# EasyEDA Pro project Dex_split.eprj, board lets_go
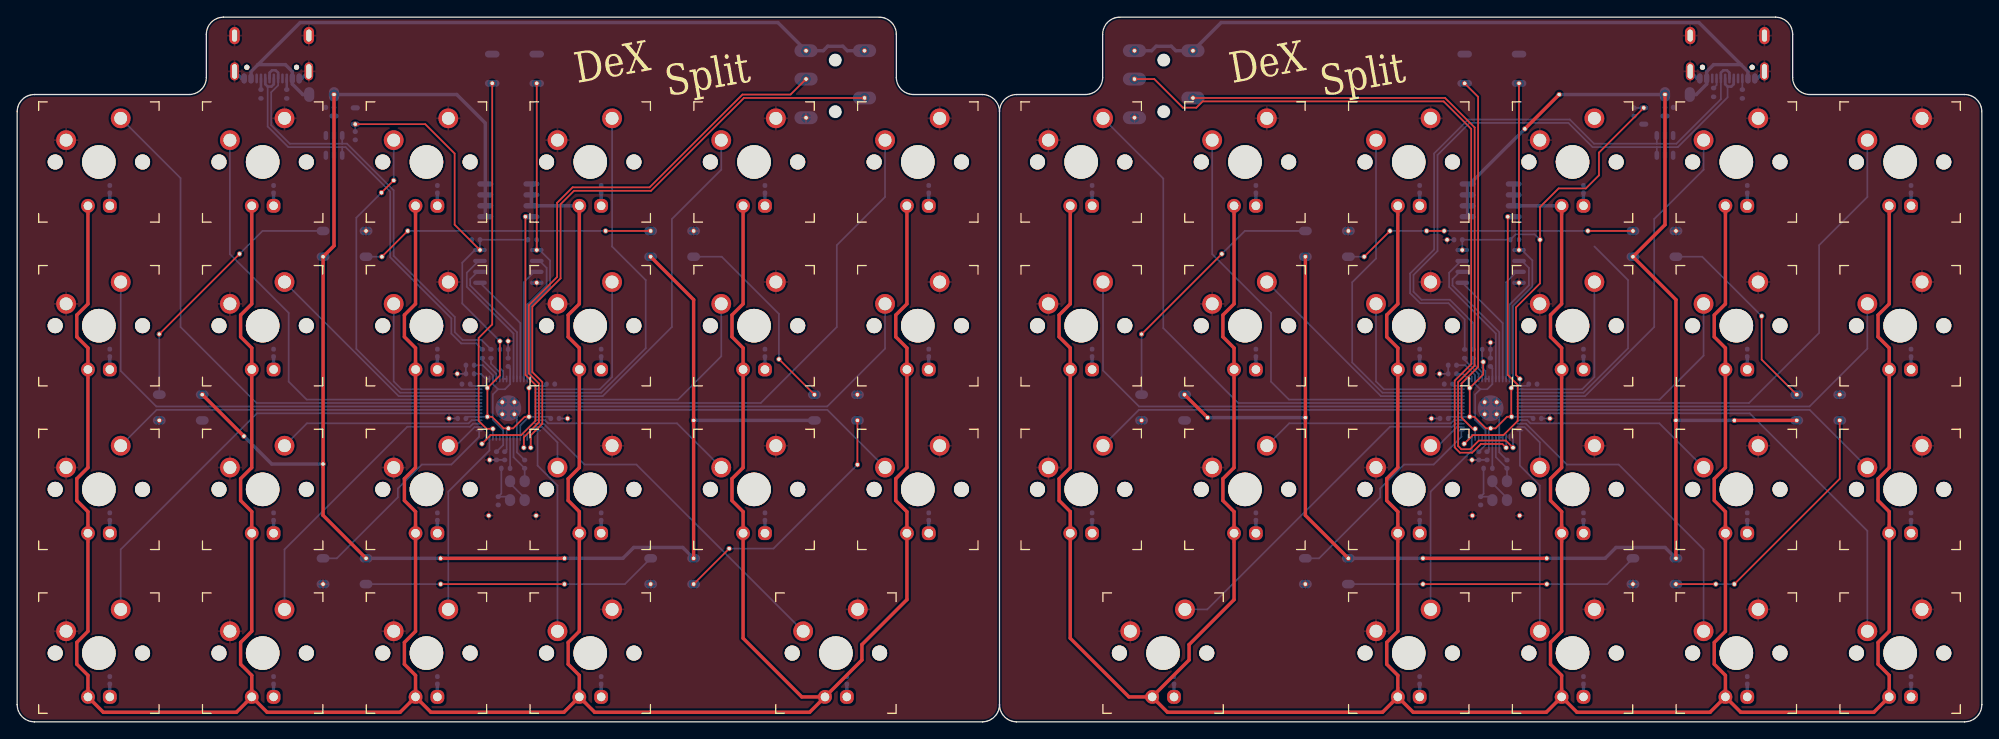
[diagram p0: board, top side]
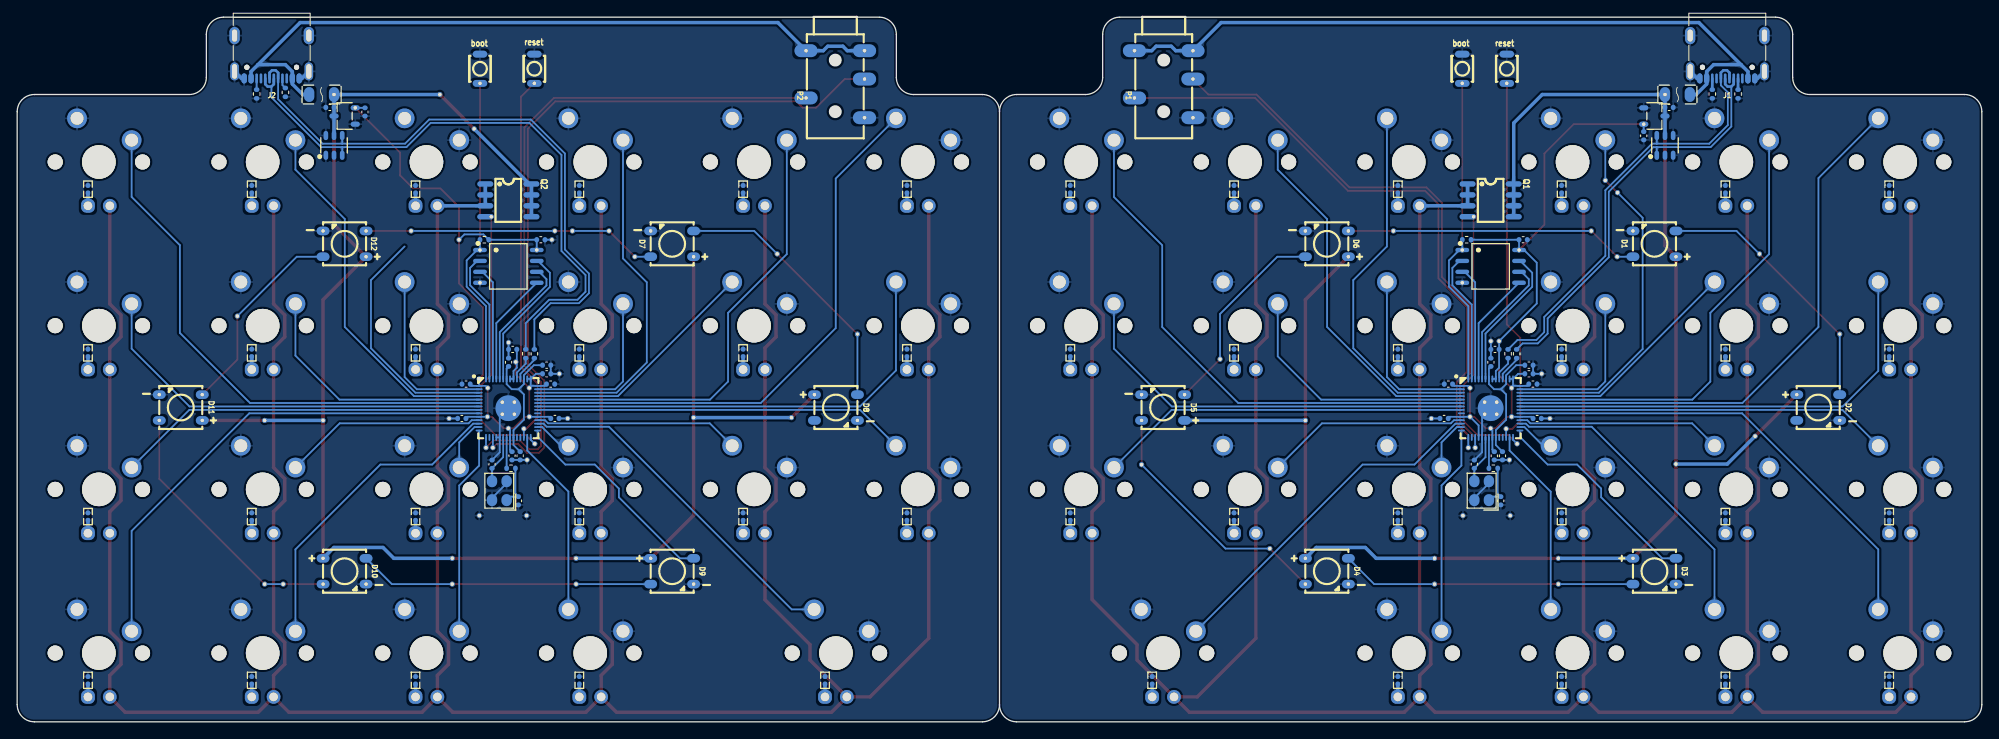
[diagram p1: board, bottom side, seen from below]

Outline 228.5 x 82 mm; copper layers: Top Layer, Bottom Layer. Coordinates in mm from the lower left corner of the outline.
Outline path: 114.25,71 arc(113.66,72.41) 112.25,73 104.25,73 arc(102.84,73.59) 102.25,75 102.25,80 arc(101.66,81.41) 100.25,82 24,82 arc(22.59,81.41) 22,80 22,75 arc(21.41,73.59) 20,73 2,73 arc(0.59,72.41) 0,71 0,2 arc(0.59,0.59) 2,0 112.25,0 arc(113.66,0.59) 114.25,2 ; 114.25,71 114.25,2 ; 114.25,71 arc(114.84,72.41) 116.25,73 124.25,73 arc(125.66,73.59) 126.25,75 126.25,80 arc(126.84,81.41) 128.25,82 204.5,82 arc(205.91,81.41) 206.5,80 206.5,75 arc(207.09,73.59) 208.5,73 226.5,73 arc(227.91,72.41) 228.5,71 228.5,2 arc(227.91,0.59) 226.5,0 116.25,0 arc(114.84,0.59) 114.25,2
Stack: Top Layer 0.035mm / Dielectric1 1.51mm FR4 er 4.5 / Bottom Layer 0.035mm

## Design rules (mm)
template: Custom Config
spacing copperThickness1oz (default): track to track 0.2, other pairs 0.152 to 0.3
spacing copperThickness2oz: track to track 0.203, other pairs 0.152 to 0.3
track width copperThickness1oz (default): min 0.127, default 0.254, max 2.54
track width copperThickness2oz: min 0.203, default 0.254, max 2.54
differential pair differentialPair (default): width min 0.127, default 0.254, max 2.54; gap min 0.152, default 0.152
via viaSize (default): diameter min 0.5, default 0.61, max 10; hole min 0.3, default 0.305, max 6.3

## Placement (name value [footprint] x y rotation side)
C1  1u  [Capacitor_SMD:C_0402_1005Metric]  192.13 71.5 0 bottom
C2  1u  [Capacitor_SMD:C_0402_1005Metric]  188.05 70.97 270 bottom
C4  1u  [Capacitor_SMD:C_0402_1005Metric]  166.92 41.5 180 bottom
C5  1u  [Capacitor_SMD:C_0402_1005Metric]  171.35 41.84 90 bottom
C6  100n  [Capacitor_SMD:C_0402_1005Metric]  166.46 39.3 180 bottom
C7  100n  [Capacitor_SMD:C_0402_1005Metric]  176.29 39.3 0 bottom
C8  100n  [Capacitor_SMD:C_0402_1005Metric]  170.87 43.34 0 bottom
C9  100n  [Capacitor_SMD:C_0402_1005Metric]  170.95 30.96 270 bottom
C10  22p  [Capacitor_SMD:C_0402_1005Metric]  170.21 25.72 90 bottom
C11  22p  [Capacitor_SMD:C_0402_1005Metric]  173.28 29.98 270 bottom
C12  100n  [Capacitor_SMD:C_0402_1005Metric]  167.59 56.1 180 bottom
C13  1u  [Capacitor_SMD:C_0402_1005Metric]  52.67 41.5 180 bottom
C14  1u  [Capacitor_SMD:C_0402_1005Metric]  57.1 41.84 90 bottom
C16  100n  [Capacitor_SMD:C_0402_1005Metric]  52.21 39.3 180 bottom
C17  100n  [Capacitor_SMD:C_0402_1005Metric]  56.62 43.34 0 bottom
C18  1u  [Capacitor_SMD:C_0402_1005Metric]  52.67 40.5 180 bottom
C19  100n  [Capacitor_SMD:C_0402_1005Metric]  51.71 35.3 180 bottom
C20  1u  [Capacitor_SMD:C_0402_1005Metric]  36.37 71.5 180 bottom
C21  22p  [Capacitor_SMD:C_0402_1005Metric]  59.03 29.98 270 bottom
C22  22p  [Capacitor_SMD:C_0402_1005Metric]  55.95 25.72 90 bottom
C23  1u  [Capacitor_SMD:C_0402_1005Metric]  39.32 68.2 270 bottom
C24  100n  [Capacitor_SMD:C_0402_1005Metric]  53.34 56.1 180 bottom
C59  1u  [Capacitor_SMD:C_0402_1005Metric]  170 30.96 270 bottom
C60  100n  [Capacitor_SMD:C_0402_1005Metric]  165.96 35.3 180 bottom
C61  100n  [Capacitor_SMD:C_0402_1005Metric]  176.79 35.3 0 bottom
C62  1u  [Capacitor_SMD:C_0402_1005Metric]  166.92 40.5 180 bottom
C63  100n  [Capacitor_SMD:C_0402_1005Metric]  56.7 30.96 270 bottom
C64  100n  [Capacitor_SMD:C_0402_1005Metric]  62.54 35.3 0 bottom
C65  100n  [Capacitor_SMD:C_0402_1005Metric]  62.04 39.3 0 bottom
C66  1u  [Capacitor_SMD:C_0402_1005Metric]  55.75 30.96 270 bottom
D1  XL-5050RGBC-WS2812B  [LED-SMD_4P-L5.0-W5.0-BL_XL-5050RGBC]  38.08 55.62 90 bottom
D2  XL-5050RGBC-WS2812B  [LED-SMD_4P-L5.0-W5.0-BL_XL-5050RGBC]  19.02 36.58 270 bottom
D3  XL-5050RGBC-WS2812B  [LED-SMD_4P-L5.0-W5.0-BL_XL-5050RGBC]  38.08 17.53 270 bottom
D4  XL-5050RGBC-WS2812B  [LED-SMD_4P-L5.0-W5.0-BL_XL-5050RGBC]  76.17 17.53 270 bottom
D5  XL-5050RGBC-WS2812B  [LED-SMD_4P-L5.0-W5.0-BL_XL-5050RGBC]  95.22 36.58 90 bottom
D6  XL-5050RGBC-WS2812B  [LED-SMD_4P-L5.0-W5.0-BL_XL-5050RGBC]  76.17 55.62 90 bottom
D7  XL-5050RGBC-WS2812B  [LED-SMD_4P-L5.0-W5.0-BL_XL-5050RGBC]  152.32 55.62 90 bottom
D8  XL-5050RGBC-WS2812B  [LED-SMD_4P-L5.0-W5.0-BL_XL-5050RGBC]  133.28 36.58 270 bottom
D9  XL-5050RGBC-WS2812B  [LED-SMD_4P-L5.0-W5.0-BL_XL-5050RGBC]  152.32 17.53 270 bottom
D10  XL-5050RGBC-WS2812B  [LED-SMD_4P-L5.0-W5.0-BL_XL-5050RGBC]  190.43 17.53 270 bottom
D11  XL-5050RGBC-WS2812B  [LED-SMD_4P-L5.0-W5.0-BL_XL-5050RGBC]  209.47 36.58 90 bottom
D12  XL-5050RGBC-WS2812B  [LED-SMD_4P-L5.0-W5.0-BL_XL-5050RGBC]  190.43 55.62 90 bottom
F1  JK-nSMD050-30  [F1206]  35.41 73 0 bottom
F3  JK-nSMD050-30  [F1206]  193.09 73 180 bottom
J1  TYPE-C 16PIN 2MD(073)  [Connector_USB:USB_C_Receptacle_Palconn_UTC16-G]  29.6 77.5 0 bottom
J2  TYPE-C 16PIN 2MD(073)  [Connector_USB:USB_C_Receptacle_Palconn_UTC16-G]  198.9 77.5 0 bottom
LMX_SW1  -  [CHERRY_MX_MILMAX]  9.5 65.15 0 top
LMX_SW2  -  [CHERRY_MX_MILMAX]  28.55 65.15 0 top
LMX_SW3  -  [CHERRY_MX_MILMAX]  47.6 65.15 0 top
LMX_SW4  -  [CHERRY_MX_MILMAX]  66.65 65.15 0 top
LMX_SW5  -  [CHERRY_MX_MILMAX]  85.7 65.15 0 top
LMX_SW6  -  [CHERRY_MX_MILMAX]  104.75 65.15 0 top
LMX_SW7  -  [CHERRY_MX_MILMAX]  9.5 46.1 0 top
LMX_SW8  -  [CHERRY_MX_MILMAX]  28.55 46.1 0 top
LMX_SW9  -  [CHERRY_MX_MILMAX]  47.6 46.1 0 top
LMX_SW10  -  [CHERRY_MX_MILMAX]  66.65 46.1 0 top
LMX_SW11  -  [CHERRY_MX_MILMAX]  85.7 46.1 0 top
LMX_SW12  -  [CHERRY_MX_MILMAX]  104.75 46.1 0 top
LMX_SW13  -  [CHERRY_MX_MILMAX]  9.5 27.05 0 top
LMX_SW14  -  [CHERRY_MX_MILMAX]  28.55 27.05 0 top
LMX_SW15  -  [CHERRY_MX_MILMAX]  47.6 27.05 0 top
LMX_SW16  -  [CHERRY_MX_MILMAX]  66.65 27.05 0 top
LMX_SW17  -  [CHERRY_MX_MILMAX]  85.7 27.05 0 top
LMX_SW18  -  [CHERRY_MX_MILMAX]  104.75 27.05 0 top
LMX_SW19  -  [CHERRY_MX_MILMAX]  9.5 8 0 top
LMX_SW20  -  [CHERRY_MX_MILMAX]  28.55 8 0 top
LMX_SW21  -  [CHERRY_MX_MILMAX]  47.6 8 0 top
LMX_SW22  -  [CHERRY_MX_MILMAX]  66.65 8 0 top
LMX_SW23  -  [CHERRY_MX_MILMAX]  95.22 8 0 top
NOREF  -  [Pad_e500]  189.18 71.45 0 top
NOREF#2  -  [Pad_e77]  149.82 54.12 0 top
NOREF#3  -  [Pad_e348]  129.95 70.3 0 top
NOREF#4  -  [Pad_e1802]  206.97 38.08 0 top
NOREF#5  -  [Pad_e353]  91.75 74.8 0 top
NOREF#6  -  [Pad_e1674]  55.25 74.3 0 top
NOREF#7  -  [Pad_e307]  49.25 16.03 0 top
NOREF#8  -  [Pad_e2623]  26.37 33.23 0 top
NOREF#9  -  [Pad_e3924]  54.85 24 0 top
NOREF#10  -  [Pad_e1706]  163.5 16.03 0 top
NOREF#11  -  [Pad_e1560]  64.02 35.3 0 top
NOREF#12  -  [Pad_e1901]  182.68 57.12 0 top
NOREF#13  -  [Pad_e988]  56.14 44.3 0 top
NOREF#14  -  [Pad_e2638]  49.25 19.03 0 top
NOREF#15  -  [Pad_e310]  63.65 16.03 0 top
NOREF#16  -  [Pad_e3943]  177.12 56.1 0 top
NOREF#17  -  [Pad_e1745]  187.93 16.03 0 top
NOREF#18  -  [Pad_e354]  129.95 74.8 0 top
NOREF#19  -  [Pad_e335]  78.67 16.03 0 top
NOREF#20  -  [Pad_e1468]  149.82 16.03 0 top
NOREF#21  -  [Pad_e2711]  138.45 35.4 0 top
NOREF#22  -  [Pad_e57]  21.52 38.08 0 top
NOREF#23  -  [Pad_e81]  206.97 35.08 0 top
NOREF#24  -  [Pad_e2373]  175.35 69.01 0 top
NOREF#25  -  [Pad_e362]  168.07 54.91 0 top
NOREF#26  -  [Pad_e2624]  35.58 30 0 top
NOREF#27  -  [Pad_e1764]  211.97 35.08 0 top
NOREF#28  -  [Pad_e2732]  192.93 35.08 0 top
NOREF#29  -  [Pad_e1749]  197.56 16.03 0 top
NOREF#30  -  [Pad_e75]  78.67 35.08 0 top
NOREF#31  -  [Pad_e1417]  57.1 44.3 0 top
NOREF#32  -  [Pad_e63]  16.52 35.08 0 top
NOREF#33  -  [Pad_e619]  56.42 35.8 0 top
NOREF#34  -  [Pad_e1703]  54.69 35.5 0 top
NOREF#35  -  [Pad_e357]  53.83 54.91 0 top
NOREF#36  -  [Pad_e2578]  174.78 39.9 0 top
NOREF#37  -  [Pad_e1443]  168.3 32.35 0 top
NOREF#38  -  [Pad_e848]  45.42 57.12 0 top
NOREF#39  -  [Pad_e427]  88.6 42.2 0 top
NOREF#40  -  [Pad_e78]  135.78 38.08 0 top
NOREF#41  -  [Pad_e2261]  178.27 35.3 0 top
NOREF#42  -  [Pad_e574]  173.97 31.9 0 top
NOREF#43  -  [Pad_e802]  58.92 31.9 0 top
NOREF#44  -  [Pad_e597]  54.05 32.35 0 top
NOREF#45  -  [Pad_e341]  168.94 35.5 0 top
NOREF#46  -  [Pad_e361]  174.68 51.09 0 top
NOREF#47  -  [Pad_e1930]  165.97 57.12 0 top
NOREF#48  -  [Pad_e360]  97.72 35.08 0 top
NOREF#49  -  [Pad_e375]  170.68 37.2 0 top
NOREF#50  -  [Pad_e820]  68.43 57.12 0 top
NOREF#51  -  [Pad_e339]  91.75 78.1 0 top
NOREF#52  -  [Pad_e343]  129.95 78.1 0 top
NOREF#53  -  [Pad_e2716]  149.82 35.4 0 top
NOREF#54  -  [Pad_e3918]  165.44 40.5 0 top
NOREF#55  -  [Pad_e3129]  36.85 73 0 top
NOREF#56  -  [Pad_e819]  73.67 57.12 0 top
NOREF#57  -  [Pad_e187]  60.42 54.91 0 top
NOREF#58  -  [Pad_e2408]  191.65 73 0 top
NOREF#59  -  [Pad_e1750]  199.72 16.03 0 top
NOREF#60  -  [Pad_e616]  173.78 38.85 0 top
NOREF#61  -  [Pad_e359]  97.72 29.92 0 top
NOREF#62  -  [Pad_e204]  60.42 74.3 0 top
NOREF#63  -  [Pad_e460]  179.34 73 0 top
NOREF#64  -  [Pad_e76]  73.67 54.12 0 top
NOREF#65  -  [Pad_e572]  173.18 31.9 0 top
NOREF#66  -  [Pad_e1905]  156.67 54.12 0 top
NOREF#67  -  [Pad_e80]  192.93 19.03 0 top
NOREF#68  -  [Pad_e333]  91.75 70.3 0 top
NOREF#69  -  [Pad_e314]  174.68 54.91 0 top
NOREF#70  -  [Pad_e62]  35.58 16.03 0 top
NOREF#71  -  [Pad_e1562]  168.35 74.3 0 top
NOREF#72  -  [Pad_e1871]  130.78 45.12 0 top
NOREF#73  -  [Pad_e1893]  187.93 57.12 0 top
NOREF#74  -  [Pad_e3922]  174.75 24 0 top
NOREF#75  -  [Pad_e832]  59.72 31.9 0 top
NOREF#76  -  [Pad_e374]  172.07 35.8 0 top
NOREF#77  -  [Pad_e3859]  170.51 41.88 0 top
NOREF#78  -  [Pad_e2729]  199.72 35.08 0 top
NOREF#79  -  [Pad_e65]  40.58 57.12 0 top
NOREF#80  -  [Pad_e345]  173.81 35.5 0 top
NOREF#81  -  [Pad_e3920]  169.25 24 0 top
NOREF#82  -  [Pad_e58]  40.58 19.03 0 top
NOREF#83  -  [Pad_e1796]  192.93 57.12 0 top
NOREF#84  -  [Pad_e621]  168.94 38.85 0 top
NOREF#85  -  [Pad_e2584]  59.53 38.85 0 top
NOREF#86  -  [Pad_e1744]  192.93 16.03 0 top
NOREF#87  -  [Pad_e60]  97.72 38.08 0 top
NOREF#88  -  [Pad_e656]  169.57 34.1 0 top
NOREF#89  -  [Pad_e1715]  211.97 38.08 0 top
NOREF#90  -  [Pad_e870]  25.86 54.45 0 top
NOREF#91  -  [Pad_e2696]  177.9 19.03 0 top
NOREF#92  -  [Pad_e2272]  173.36 58.78 0 top
NOREF#93  -  [Pad_e849]  42.42 54.12 0 top
NOREF#94  -  [Pad_e340]  98.55 78.1 0 top
NOREF#95  -  [Pad_e3877]  169.2 30.48 0 top
NOREF#96  -  [Pad_e1563]  174.68 74.3 0 top
NOREF#97  -  [Pad_e1288]  42.37 61.58 0 top
NOREF#98  -  [Pad_e376]  172.07 37.2 0 top
NOREF#99  -  [Pad_e1300]  43.79 63 0 top
NOREF#100  -  [Pad_e79]  154.82 19.03 0 top
NOREF#101  -  [Pad_e59]  78.67 19.03 0 top
NOREF#102  -  [Pad_e2646]  63.65 19.03 0 top
NOREF#103  -  [Pad_e1412]  55.33 34.1 0 top
NOREF#104  -  [Pad_e885]  16.52 45.12 0 top
NOREF#105  -  [Pad_e367]  171.38 34.15 0 top
NOREF#106  -  [Pad_e1708]  177.9 16.03 0 top
NOREF#107  -  [Pad_e346]  136.75 78.1 0 top
NOREF#108  -  [Pad_e352]  98.55 72.6 0 top
NOREF#109  -  [Pad_e1903]  159.67 57.12 0 top
NOREF#110  -  [Pad_e331]  60.42 51.09 0 top
NOREF#111  -  [Pad_e355]  136.75 72.6 0 top
NOREF#112  -  [Pad_e1868]  140.11 54.45 0 top
NOREF#113  -  [Pad_e3976]  166.31 56.1 0 top
NOREF#114  -  [Pad_e3930]  51.19 40.5 0 top
NOREF#115  -  [Pad_e1687]  57.12 34.15 0 top
NOREF#116  -  [Pad_e1923]  163.93 57.12 0 top
NOREF#117  -  [Pad_e618]  56.42 37.2 0 top
NOREF#118  -  [Pad_e377]  170.68 35.8 0 top
NOREF#119  -  [Pad_e381]  92.72 38.08 0 top
NOREF#120  -  [Pad_e1880]  130.78 35.08 0 top
NOREF#121  -  [Pad_e1864]  154.82 57.12 0 top
NOREF#122  -  [Pad_e1359]  50.23 35.3 0 top
NOREF#123  -  [Pad_e280]  59.11 58.78 0 top
NOREF#124  -  [Pad_e2695]  163.5 19.03 0 top
NOREF#125  -  [Pad_e2582]  59.53 35.5 0 top
NOREF#126  -  [Pad_e615]  57.83 37.2 0 top
NOREF#127  -  [Pad_e66]  78.67 57.12 0 top
NOREF#128  -  [Pad_e2258]  164.48 35.3 0 top
NOREF#129  -  [Pad_e84]  187.93 54.12 0 top
NOREF#130  -  [Pad_e2596]  54.69 38.85 0 top
NOREF#131  -  [Pad_e88]  39.32 69.55 0 top
NOREF#132  -  [Pad_e56]  35.58 54.12 0 top
NOREF#133  -  [Pad_e3923]  60.35 24 0 top
NOREF#134  -  [Pad_e344]  82.81 20.16 0 top
NOREF#135  -  [Pad_e614]  57.83 35.8 0 top
NOREF#136  -  [Pad_e3885]  171.35 44.14 0 top
NOREF#137  -  [Pad_e3925]  54.95 30.48 0 top
NOREF#138  -  [Pad_e1814]  202.9 47.21 0 top
NOREF#139  -  [Pad_e61]  73.67 16.03 0 top
P1  KH-PJ-327F-SMT  [AUDIO-SMD_KH-PJ-327F-SMT]  95.15 74.2 270 bottom
P2  KH-PJ-327F-SMT  [AUDIO-SMD_KH-PJ-327F-SMT]  133.35 74.2 270 bottom
Q1  DMN3018SSS-13  [SOP-8_L4.9-W3.9-P1.27-LS6.0-BL]  57.12 60.69 270 bottom
Q2  DMN3018SSS-13  [SOP-8_L4.9-W3.9-P1.27-LS6.0-BL]  171.38 60.69 270 bottom
R1  5.1k  [Resistor_SMD:R_0402_1005Metric]  197.31 73.25 270 bottom
R2  5.1k  [Resistor_SMD:R_0402_1005Metric]  200.65 73.06 270 bottom
R4  27  [Resistor_SMD:R_0402_1005Metric]  169.35 42.83 270 bottom
R5  27  [Resistor_SMD:R_0402_1005Metric]  168.35 42.83 270 bottom
R6  1k  [Resistor_SMD:R_0402_1005Metric]  171.06 29.5 0 bottom
R8  10k  [Resistor_SMD:R_0402_1005Metric]  174.16 56.1 0 bottom
R10  27  [Resistor_SMD:R_0402_1005Metric]  55.1 42.83 270 bottom
R11  27  [Resistor_SMD:R_0402_1005Metric]  54.1 42.83 270 bottom
R12  5.1k  [Resistor_SMD:R_0402_1005Metric]  28.35 73.06 270 bottom
R13  5.1k  [Resistor_SMD:R_0402_1005Metric]  31.35 73.06 270 bottom
R16  1k  [Resistor_SMD:R_0402_1005Metric]  56.81 29.5 0 bottom
R17  10k  [Resistor_SMD:R_0402_1005Metric]  59.92 56.1 0 bottom
R20  500Ω  [R0402]  10.77 61.98 270 bottom
R21  500Ω  [R0402]  29.82 61.98 270 bottom
R22  500Ω  [R0402]  48.87 61.98 270 bottom
R23  500Ω  [R0402]  67.92 61.98 270 bottom
R24  500Ω  [R0402]  86.97 61.98 270 bottom
R25  500Ω  [R0402]  106.02 61.98 270 bottom
R26  500Ω  [R0402]  10.77 42.93 270 bottom
R27  500Ω  [R0402]  29.82 42.93 270 bottom
R28  500Ω  [R0402]  48.87 42.93 270 bottom
R29  500Ω  [R0402]  67.92 42.93 270 bottom
R30  500Ω  [R0402]  86.97 42.93 270 bottom
R31  500Ω  [R0402]  106.02 42.93 270 bottom
R32  500Ω  [R0402]  10.77 23.88 270 bottom
R33  500Ω  [R0402]  29.82 23.88 270 bottom
R34  500Ω  [R0402]  48.87 23.88 270 bottom
R35  500Ω  [R0402]  67.92 23.88 270 bottom
R36  500Ω  [R0402]  86.97 23.88 270 bottom
R37  500Ω  [R0402]  106.02 23.88 270 bottom
R38  500Ω  [R0402]  10.77 4.83 270 bottom
R39  500Ω  [R0402]  29.82 4.83 270 bottom